# Altium schematic sheet Sheet1.SCHDOC
size 604 x 427 mm
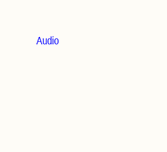
[diagram p0: Sheet1.SCHDOC, top column 1 of 4]
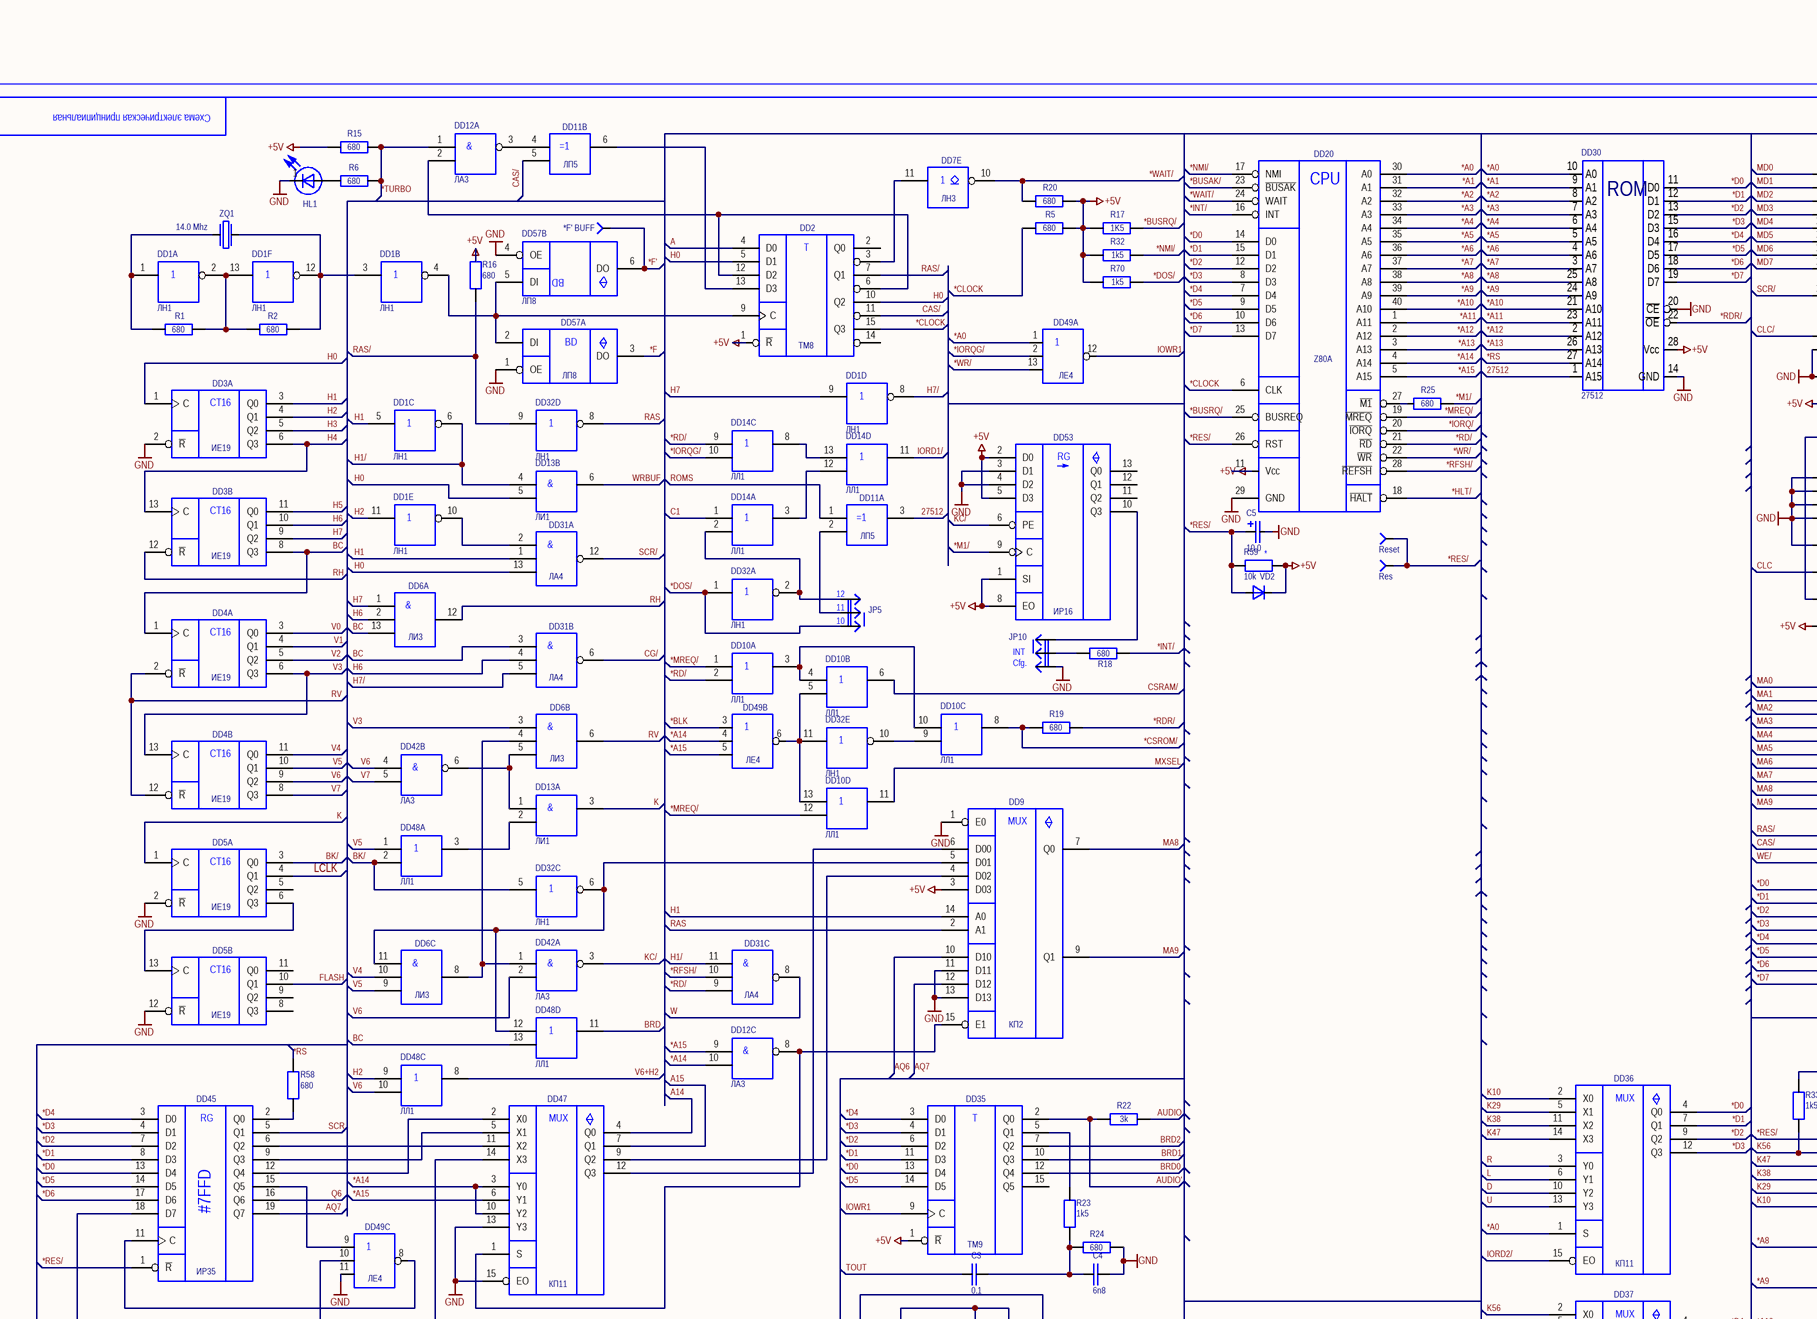
[diagram p1: Sheet1.SCHDOC, top column 3 of 4]
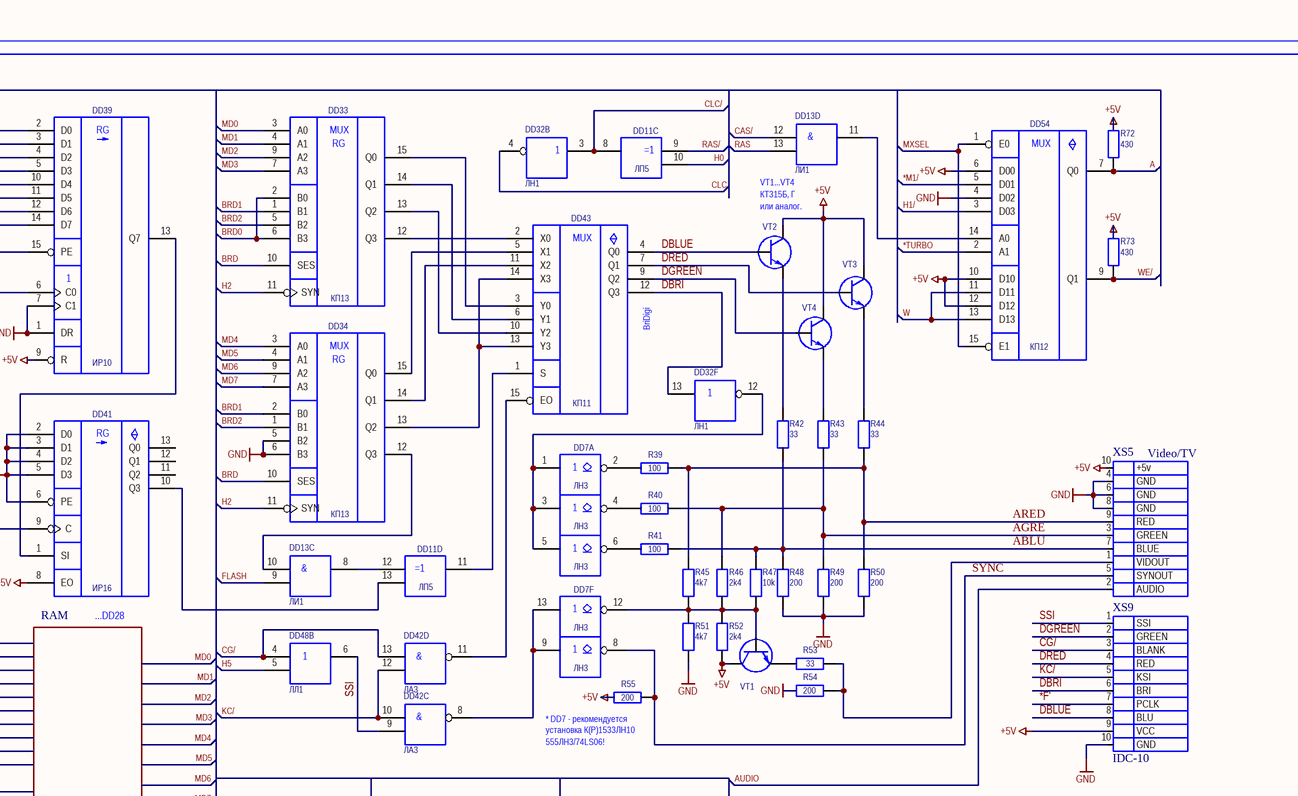
[diagram p2: Sheet1.SCHDOC, top column 4 of 4]
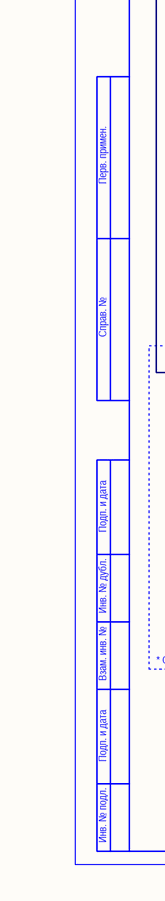
[diagram p3: Sheet1.SCHDOC, bottom column 2 of 4]
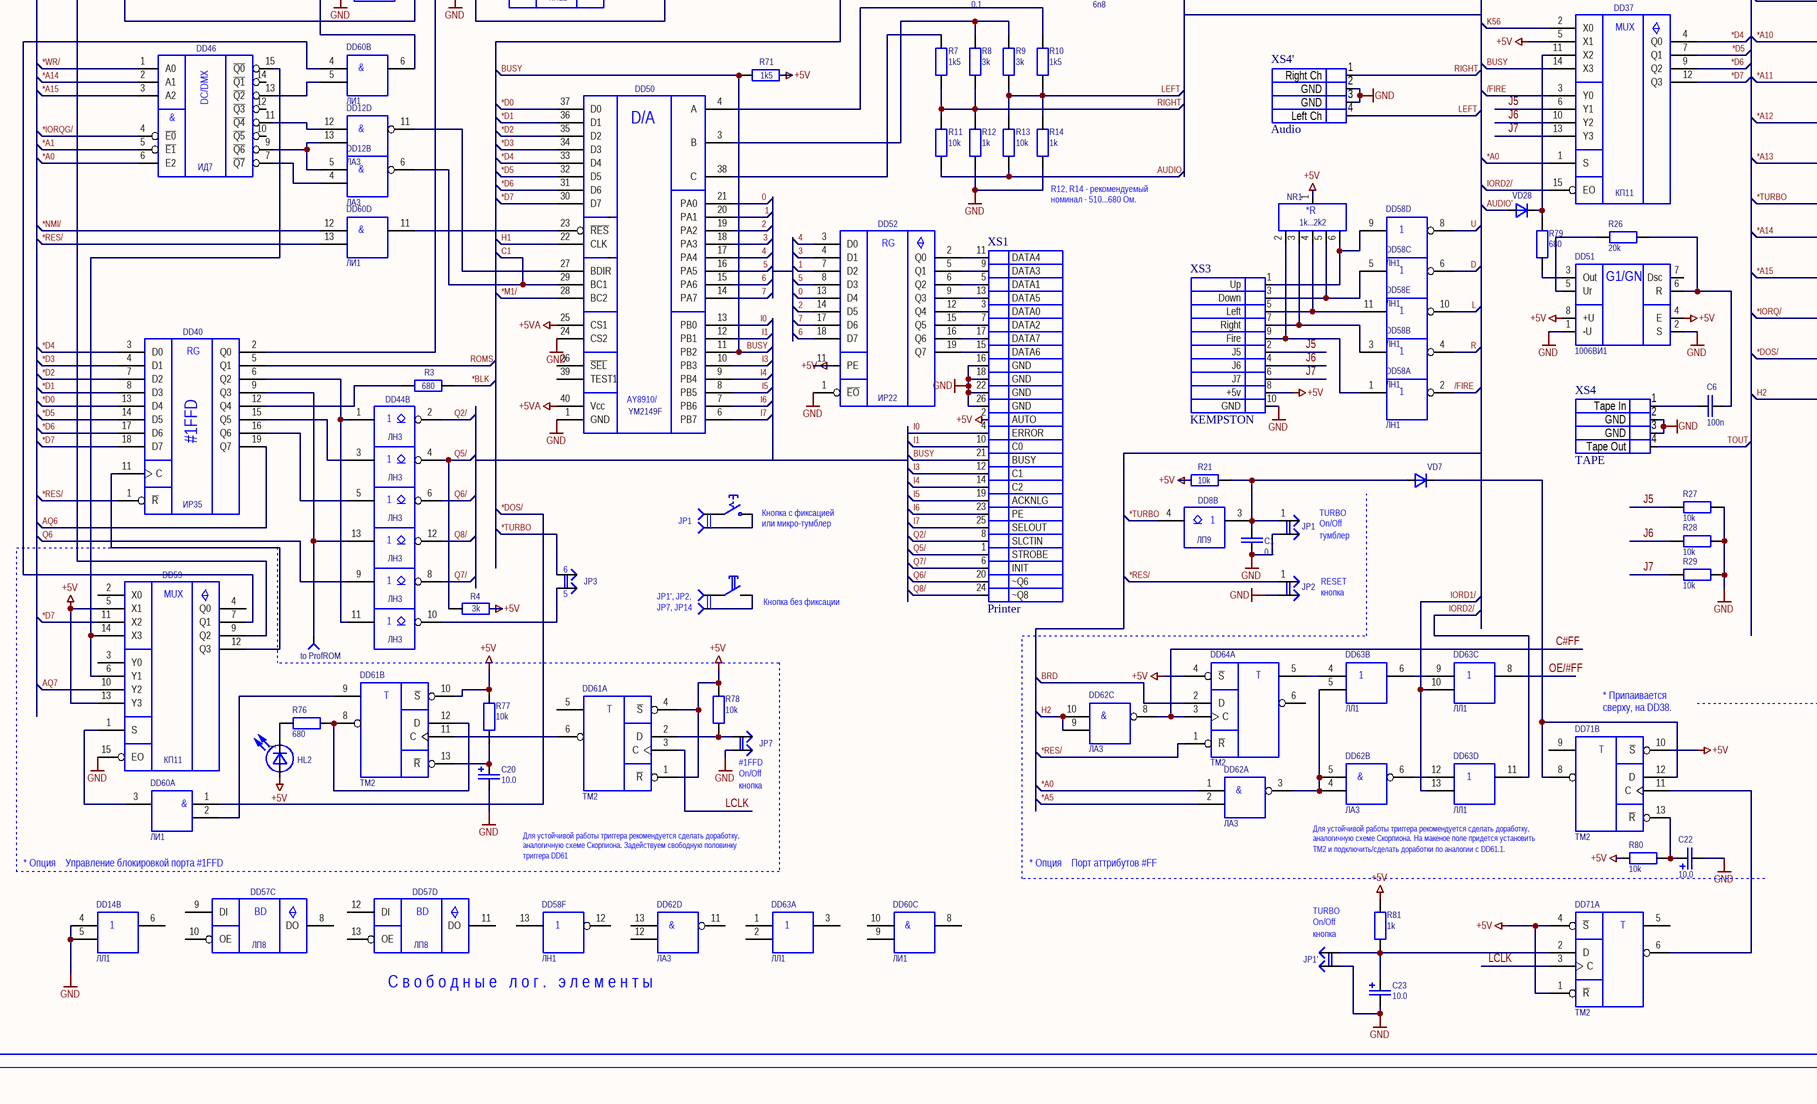
[diagram p4: Sheet1.SCHDOC, bottom column 3 of 4]
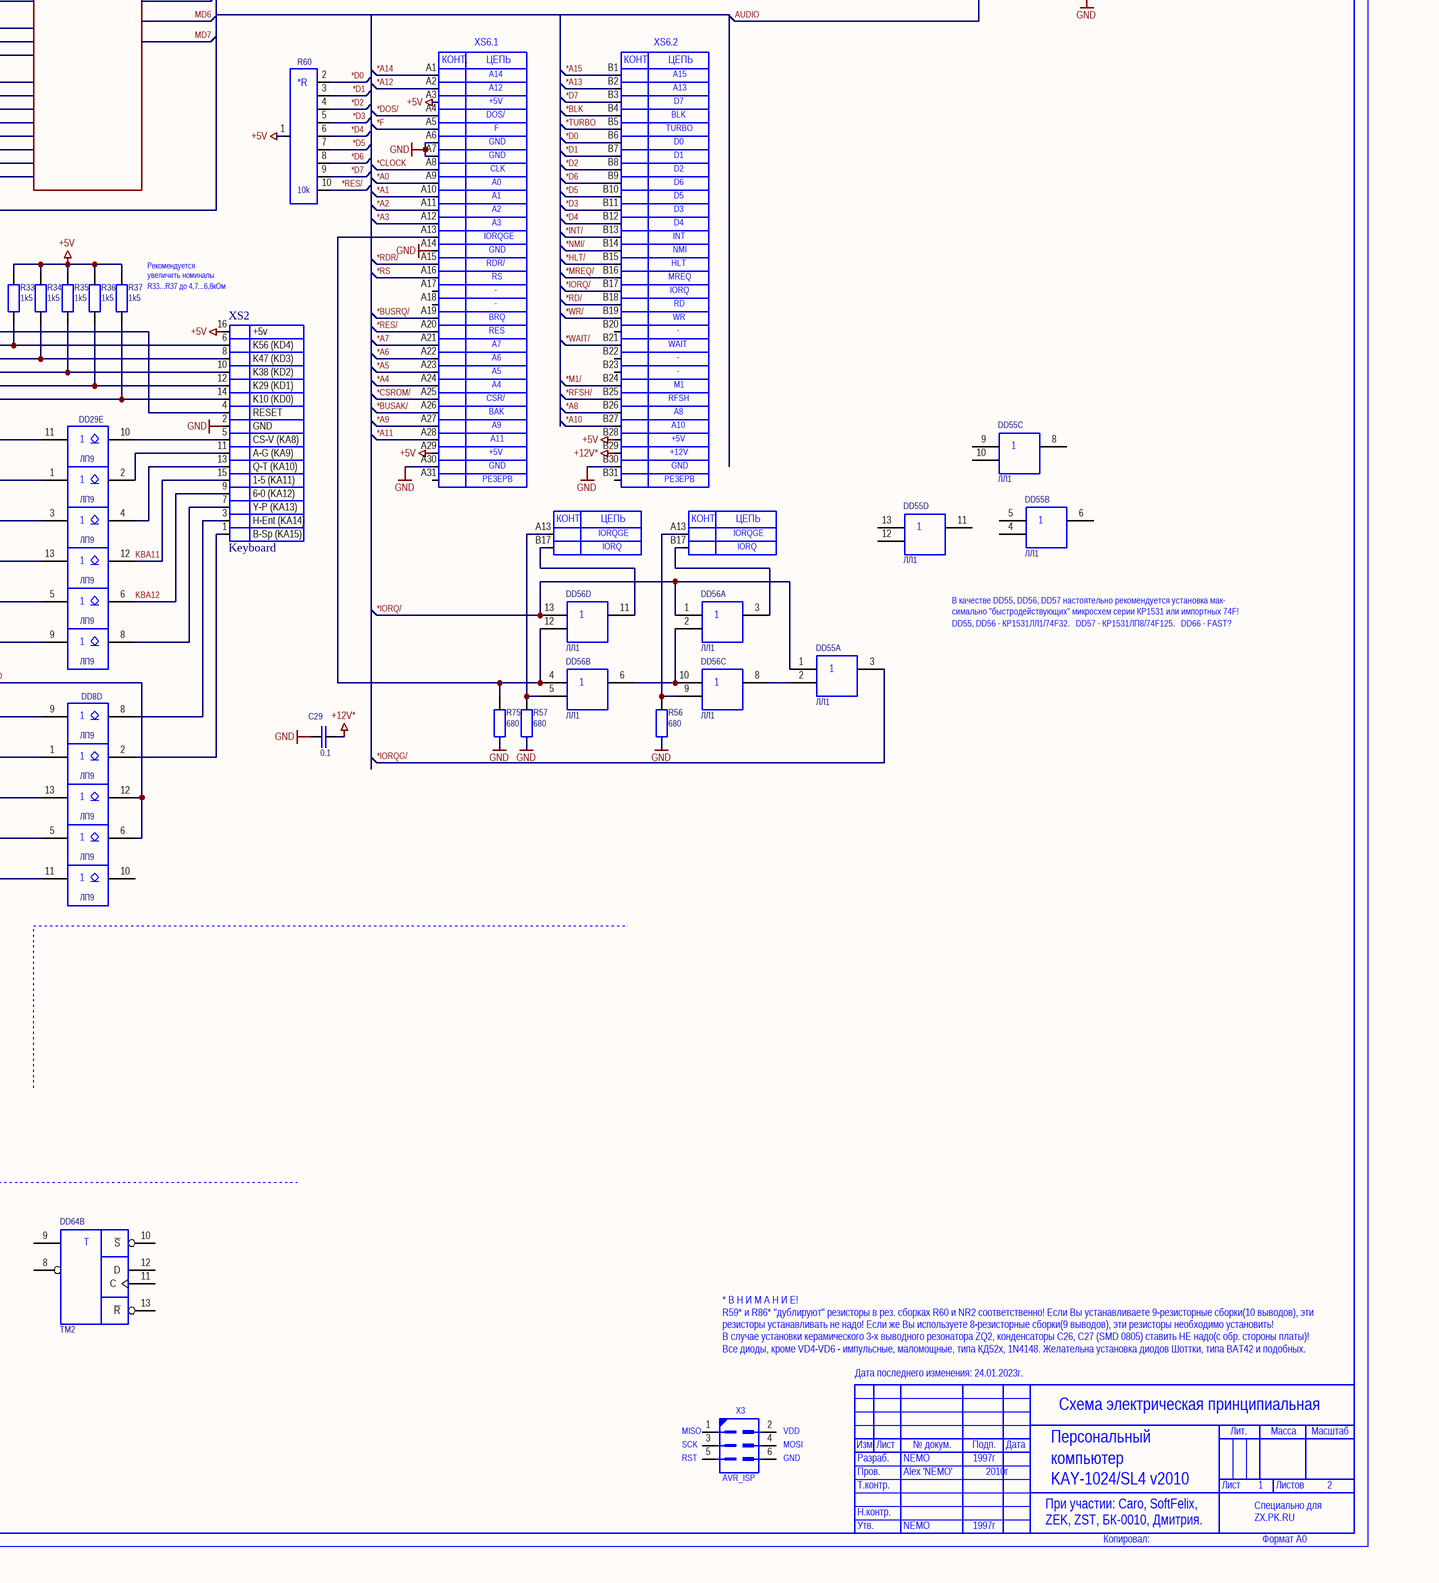
[diagram p5: Sheet1.SCHDOC, bottom column 4 of 4]

## Parts
C1  value 0.1  [CAP]
C3  value 0.1  [CAP]
C4  value 6n8  [CAP]
C5  value 10.0  [AL CAP P=2.5 D=3]  (hidden comment: CP)
C6  value 100n  [CAP]
C20  value 10.0  [AL CAP P=2.5 D=3]  (hidden comment: CP)
C22  value 10.0  [AL CAP P=2.5 D=3]  (hidden comment: CP)
C23  value 10.0  [AL CAP P=2.5 D=3]  (hidden comment: CP)
C29  value 0.1  [CAP]
DD1  Type: ЛН1  [DIP14]  (hidden comment: К555ЛН1)  (parts A,B,C,D,E,F of 6)
DD2  Type: ТМ8  [DIP16]
DD3  Type: ИЕ19  [DIP14]  (parts A,B of 2)
DD4  Type: ИЕ19  [DIP14]  (parts A,B of 2)
DD5  Type: ИЕ19  [DIP14]  (parts A,B of 2)
DD6  Type: ЛИ3  [DIP14]  (parts A,B,C of 3)
DD7  Type: ЛН3  [DIP14]  (parts A,B,C,D,E,F of 6)
DD8  Type: ЛП9  [DIP14]  (parts A,B,C,D,E,F of 6)
DD9  Type: КП2  [DIP16]
DD10  Type: ЛЛ1  [DIP14]  (hidden comment: К555ЛЛ1)  (parts A,B,C,D of 4)
DD11  Type: ЛП5  [DIP14]  (parts A,B,C,D of 4)
DD12  Type: ЛА3  [DIP14]  (hidden comment: К555ЛА3)  (parts A,B,C,D of 4)
DD13  Type: ЛИ1  [DIP14]  (hidden comment: К555ЛИ1)  (parts A,B,C,D of 4)
DD14  Type: ЛЛ1  [DIP14]  (hidden comment: К555ЛЛ1)  (parts A,B,C,D of 4)
DD20  Type: Z80A  [DIP40]
DD29  Type: ЛП9  [DIP14]  (parts A,B,C,D,E,F of 6)
DD30  27512  [DIP28]
DD31  Type: ЛА4  [DIP14]  (parts A,B,C of 3)
DD32  Type: ЛН1  [DIP14]  (hidden comment: К555ЛН1)  (parts A,B,C,D,E,F of 6)
DD33  Type: КП13  [DIP16]
DD34  Type: КП13  [DIP16]
DD35  Type: ТМ9  [DIP16]
DD36  Type: КП11  [DIP16]
DD37  Type: КП11  [DIP16]
DD39  Type: ИР10  [DIP16]
DD40  Type: ИР35  [DIP20]
DD41  Type: ИР16  [DIP14]
DD42  Type: ЛА3  [DIP14]  (hidden comment: К555ЛА3)  (parts A,B,C,D of 4)
DD43  Type: КП11  [DIP16]
DD44  Type: ЛН3  [DIP14]  (parts A,B,C,D,E,F of 6)
DD45  Type: ИР35  [DIP20]
DD46  Type: ИД7  [DIP16]
DD47  Type: КП11  [DIP16]
DD48  Type: ЛЛ1  [DIP14]  (hidden comment: К555ЛЛ1)  (parts A,B,C,D of 4)
DD49  Type: ЛЕ4  [DIP14]  (parts A,B,C of 3)
DD50  (no value)  [DIP40]
DD51  Type: 1006ВИ1  [DIP8]
DD52  Type: ИР22  [DIP20]
DD53  Type: ИР16  [DIP14]
DD54  Type: КП12  [DIP16]
DD55  Type: ЛЛ1  [DIP14]  (hidden comment: К555ЛЛ1)  (parts A,B,C,D of 4)
DD56  Type: ЛЛ1  [DIP14]  (hidden comment: К555ЛЛ1)  (parts A,B,C,D of 4)
DD57  Type: ЛП8  [DIP14]  (parts A,B,C,D of 4)
DD58  Type: ЛН1  [DIP14]  (hidden comment: К555ЛН1)  (parts A,B,C,D,E,F of 6)
DD59  Type: КП11  [DIP16]
DD60  Type: ЛИ1  [DIP14]  (hidden comment: К555ЛИ1)  (parts A,B,C,D of 4)
DD61  Type: ТМ2  [DIP14]  (hidden comment: К555ТМ2)  (parts A,B of 2)
DD62  Type: ЛА3  [DIP14]  (hidden comment: К555ЛА3)  (parts A,B,C,D of 4)
DD63  Type: ЛЛ1  [DIP14]  (hidden comment: К555ЛЛ1)  (parts A,B,C,D of 4)
DD64  Type: ТМ2  [DIP14]  (hidden comment: К555ТМ2)  (parts A,B of 2)
DD71  Type: ТМ2  [DIP14]  (hidden comment: К555ТМ2)  (parts A,B of 2)
HL1  (no value)  [PLS-2]
HL2  LED #1FFD  [PLS-2]  (value not drawn)
JP1  TURBO  [PLS-2]  (value not drawn)
JP1'  TURBO  [PLS-2]  (value not drawn)
JP2  TURBO  [PLS-2]  (value not drawn)
JP3  5 6  [PLS-2]  (value not drawn)
JP5  (no value)  [PLS-3]
JP7  Blk#1FFD  [PLS-2]  (value not drawn)
JP10  INT Cfg  [PLS-3]  (value not drawn)
KP7  Reset  [Socket]
KP8  Res  [Socket]
KP9  to ProfROM  [Socket]
KP10  *F' BUFF  [Socket]
NR1  value 1k...2k2  [SIL6]
R1  value 680  [RES]
R2  value 680  [RES]
R3  value 680  [RES]
R4  value 3k  [RES]
R5  value 680  [RES]
R6  value 680  [RES]
R7  value 1k5  [RES]
R8  value 3k  [RES]
R9  value 3k  [RES]
R10  value 1k5  [RES]
R11  value 10k  [RES]
R12  value 1k  [RES]
R13  value 10k  [RES]
R14  value 1k  [RES]
R15  value 680  [RES]
R16  value 680  [RES]
R17  value 1K5  [RES]
R18  value 680  [RES]
R19  value 680  [RES]
R20  value 680  [RES]
R21  value 10k  [RES]
R22  value 3k  [RES]
R23  value 1k5  [RES]
R24  value 680  [RES]
R25  value 680  [RES]
R26  value 20k  [RES]
R27  value 10k  [RES]
R28  value 10k  [RES]
R29  value 10k  [RES]
R32  value 1k5  [RES]
R33  value 1k5  [RES]
R34  value 1k5  [RES]
R35  value 1k5  [RES]
R36  value 1k5  [RES]
R37  value 1k5  [RES]
R39  value 100  [RES]
R40  value 100  [RES]
R41  value 100  [RES]
R42  value 33  [RES]
R43  value 33  [RES]
R44  value 33  [RES]
R45  value 4k7  [RES]
R46  value 2k4  [RES]
R47  value 10k  [RES]
R48  value 200  [RES]
R49  value 200  [RES]
R50  value 200  [RES]
R51  value 4k7  [RES]
R52  value 2k4  [RES]
R53  value 33  [RES]
R54  value 200  [RES]
R55  value 200  [RES]
R56  value 680  [RES]
R57  value 680  [RES]
R58  value 680  [RES]
R59  value 10k  [RES]
R60  value 10k  [SIL10]
R70  value 1k5  [RES]
R71  value 1k5  [RES]
R72  value 430  [RES]
R73  value 430  [RES]
R75  value 680  [RES]
R76  value 680  [RES]
R77  value 10k  [RES]
R78  value 10k  [RES]
R79  value 680  [RES]
R80  value 10k  [RES]
R81  value 1k  [RES]
SB2  (no value)  (graphical)
SB4  (no value)  (graphical)
VD2  D2  [1N4148]  (value not drawn)
VD7  D7  [1N4148]  (value not drawn)
VD28  D28  [1N4148]  (value not drawn)
VT1  (no value)  [VT]
VT2  (no value)  [VT]
VT3  (no value)  [VT]
VT4  (no value)  [VT]
X6  (no value)  (graphical)
XS1  Printer  [BH-26]
XS2  Keyboard  [BH-16]
XS3  KEMPSTON  [BH-10]
XS4  TAPE  [STEREO_CONN]
XS4'  Audio  [STEREO_CONN]
XS5  Video/TV  [BH-10]
XS6  (no value)  [SLOT62_ZXSLOT(Primary)]  (parts A,B,C,D,E,F,G,H,I,J,K,L,M,N,O,P,Q,R,S,T,U,V,W,X,Y,Z,27,28,29,30,31,32,33,34,35,36,37,38,39,40,41,42,43,44,45,46,47,48,49,50,51,52,53,54,55,56,57,58,59,60,61,62 of 62)
XS7  (no value)  [SLOT62_ZXSLOT(Primary)]  (parts M,48 of 62)
XS8  (no value)  [SLOT62_ZXSLOT(Primary)]  (parts M,48 of 62)
XS9  IDC-10  [BH-10]
XS46  (no value)  (graphical)
XS47  (no value)  (graphical)
XS48  (no value)  (graphical)
XS49  (no value)  (graphical)
ZQ1  value 14.0 Mhz  [HC49]

## Blocks framed on the sheet
* Опция    Управление блокировкой порта #1FFD: C20 DD59-DD61 HL2 JP7 R76-R78

## Sub-sheets
RAM = ?: no entries

## Nets
+5V: DD1.14(+5V) DD2.1(~{R}) DD2.16(+5V) DD3.14(+5V) DD4.14(+5V) DD5.14(+5V) DD6.14(+5V) DD7.14(+5V) DD8.14(+5V) DD9.3(D03) DD9.16(+5V) DD10.14(+5V) DD11.14(+5V) DD12.14(+5V) DD13.14(+5V) DD14.14(+5V) DD20.11(Vcc) DD29.14(+5V) DD30.28(Vcc) DD31.14(+5V) DD32.14(+5V) DD33.16(+5V) DD34.16(+5V) DD35.1(~{R}) DD35.16(+5V) DD36.16(+5V) DD37.5(X1) DD37.16(+5V) DD39.9(R) DD39.16(+5V) DD40.20(+5V) DD41.8(EO) DD41.14(+5V) DD42.14(+5V) DD43.16(+5V) DD44.14(+5V) DD45.20(+5V) DD46.16(+5V) DD47.16(+5V) DD48.14(+5V) DD49.14(+5V) DD51.4(E) DD51.8(+U) DD52.11(PE) DD52.20(+5V) DD53.1(SI) DD53.2(D0) DD53.5(D3) DD53.8(EO) DD53.14(+5V) DD54.6(D00) DD54.10(D10) DD54.12(D12) DD54.16(+5V) DD55.14(+5V) DD56.14(+5V) DD57.14(+5V) DD58.14(+5V) DD59.5(X1) DD59.13(Y3) DD59.16(+5V) DD60.14(+5V) DD61.1(~{R}) DD61.4(~{S}) DD61.10(~{S}) DD61.14(+5V) DD62.14(+5V) DD63.14(+5V) DD64.4(~{S}) DD64.14(+5V) DD71.1(~{R}) DD71.4(~{S}) DD71.10(~{S}) DD71.14(+5V) HL2.2 NR1.1 R4.2 R5.2 R15.1 R16.2 R17.1 R20.2 R21.1 R32.1 R33.2 R34.2 R35.2 R36.2 R37.2 R52.1 R55.1 R59.1 R60.1 R70.1 R71.2 R72.2 R73.2 R77.1 R78.2 R80.2 R81.2 VD2.2 VT1.K VT2.K VT3.K VT4.K XS1.2(AUTO) XS2.16(+5v) XS3.8(+5v) XS5.10(+5v) XS6.A3 XS6.A29 XS6.B28 XS9.9(VCC)
+5VA: DD50.25(CS1) DD50.40(Vcc)
+12V*: C29.2 XS6.B29
GND: C1.2 C4.2 C5.2 C20.2 C22.2 C23.2 C29.1 DD1.7(GND) DD2.8(GND) DD3.2(~{R}) DD3.7(GND) DD4.7(GND) DD5.2(~{R}) DD5.7(GND) DD5.12(~{R}) DD6.7(GND) DD7.7(GND) DD8.7(GND) DD9.1(E0) DD9.8(GND) DD9.11(D11) DD9.13(D13) DD10.7(GND) DD11.7(GND) DD12.7(GND) DD13.7(GND) DD14.4 DD14.5 DD14.7(GND) DD20.29(GND) DD29.7(GND) DD30.14(GND) DD30.20(~{CE}) DD31.7(GND) DD32.7(GND) DD33.8(GND) DD34.5(B2) DD34.6(B3) DD34.8(GND) DD35.8(GND) DD36.8(GND) DD37.8(GND) DD39.1(DR) DD39.7(C1) DD39.8(GND) DD40.10(GND) DD41.2(D0) DD41.3(D1) DD41.4(D2) DD41.5(D3) DD41.6(PE) DD41.7(GND) DD42.7(GND) DD43.8(GND) DD44.7(GND) DD45.10(GND) DD46.8(GND) DD47.8(GND) DD47.13(Y3) DD47.15(EO) DD48.7(GND) DD49.7(GND) DD49.11 DD50.1(GND) DD50.24(CS2) DD51.1(-U) DD51.2(S) DD52.1(~{EO}) DD52.10(GND) DD53.3(D1) DD53.4(D2) DD53.7(GND) DD54.4(D02) DD54.8(GND) DD55.7(GND) DD56.7(GND) DD57.1(OE) DD57.4(OE) DD57.7(GND) DD58.7(GND) DD59.8(GND) DD59.15(EO) DD60.7(GND) DD61.7(GND) DD62.7(GND) DD63.7(GND) DD64.7(GND) DD71.7(GND) HL1.1 JP1.2 JP1'.2 JP2.2 JP7.2 JP10.1 R12.1 R14.1 R24.2 R27.1 R28.1 R29.1 R48.1 R49.1 R50.1 R51.1 R54.1 R56.1 R57.1 R75.1 XS1.16(GND) XS1.18(GND) XS1.22(GND) XS1.26(GND) XS2.2(GND) XS3.10(GND) XS4.2(GND) XS4.3(GND) XS4'.2(GND) XS4'.3(GND) XS5.4(GND) XS5.6(GND) XS5.8(GND) XS6.A6 XS6.A7 XS6.A14 XS6.A30 XS6.B30 XS9.10(GND)
0: DD50.21(PA0) DD52.13(D4)
1: DD50.20(PA1) DD52.7(D2)
2: DD50.19(PA2) DD52.14(D5)
3: DD50.18(PA3) DD52.4(D1)
4: DD50.17(PA4) DD52.3(D0)
5: DD50.16(PA5) DD52.8(D3)
6: DD50.15(PA6) DD52.18(D7)
7: DD50.14(PA7) DD52.17(D6)
27512: DD11.3 DD30.1(A15)
*A0: DD20.30(A0) DD30.10(A0) DD36.1(S) DD37.1(S) DD46.6(E2) DD49.1 DD62.1 XS6.A9
*A1: DD20.31(A1) DD30.9(A1) DD46.5(~{E1}) XS6.A10
*A2: DD20.32(A2) DD30.8(A2) XS6.A11
*A3: DD20.33(A3) DD30.7(A3) XS6.A12
*A4: DD20.34(A4) DD30.6(A4) XS6.A24
*A5: DD20.35(A5) DD30.5(A5) DD62.2 XS6.A23
*A6: DD20.36(A6) DD30.4(A6) XS6.A22
*A7: DD20.37(A7) DD30.3(A7) XS6.A21
*A8: DD20.38(A8) DD29.11 DD30.25(A8) XS6.B26
*A9: DD20.39(A9) DD29.1 DD30.24(A9) XS6.A27
*A10: DD20.40(A10) DD29.3 DD30.21(A10) XS6.B27
*A11: DD20.1(A11) DD29.13 DD30.23(A11) XS6.A28
*A12: DD20.2(A12) DD29.5 DD30.2(A12) XS6.A2
*A13: DD20.3(A13) DD29.9 DD30.26(A13) XS6.B2
*A14: DD8.9 DD12.10 DD20.4(A14) DD46.2(A1) DD47.3(Y0) DD47.10(Y2) DD49.4 XS6.A1
*A15: DD8.1 DD12.9 DD20.5(A15) DD46.3(A2) DD47.6(Y1) DD49.5 XS6.B1
*BLK: DD49.3 R3.2 XS6.B4
*BUSAK/: DD20.23(~{BUSAK}) XS6.A26
*BUSRQ/: DD20.25(BUSREQ) R17.2 XS6.A19
*CLOCK: DD2.15(Q3) DD20.6(CLK) R5.1 XS6.A8
*CSROM/: DD10.8 R19.1 XS6.A25
*D0: DD20.14(D0) DD30.11(D0) DD35.13(D4) DD36.4(Q0) DD40.13(D4) DD45.13(D4) DD50.37(D0) R60.2 XS6.B6
*D1: DD20.15(D1) DD30.12(D1) DD35.11(D3) DD36.7(Q1) DD40.8(D3) DD45.8(D3) DD50.36(D1) R60.3 XS6.B7
*D2: DD20.12(D2) DD30.13(D2) DD35.6(D2) DD36.9(Q2) DD40.7(D2) DD45.7(D2) DD50.35(D2) R60.4 XS6.B8
*D3: DD20.8(D3) DD30.15(D3) DD35.4(D1) DD36.12(Q3) DD40.4(D1) DD45.4(D1) DD50.34(D3) R60.5 XS6.B11
*D4: DD20.7(D4) DD30.16(D4) DD35.3(D0) DD37.4(Q0) DD40.3(D0) DD45.3(D0) DD50.33(D4) R60.6 XS6.B12
*D5: DD20.9(D5) DD30.17(D5) DD35.14(D5) DD37.7(Q1) DD40.14(D5) DD45.14(D5) DD50.32(D5) R60.7 XS6.B10
*D6: DD20.10(D6) DD30.18(D6) DD37.9(Q2) DD40.17(D6) DD45.17(D6) DD50.31(D6) R60.8 XS6.B9
*D7: DD20.13(D7) DD30.19(D7) DD37.12(Q3) DD40.18(D7) DD50.30(D7) DD59.11(X2) R60.9 XS6.B3
*DOS/: DD8.5 DD32.1 DD60.1 JP5.1 R70.2 XS6.A4
*F: DD57.3(DO) XS6.A5
*F': DD57.6(DO) KP10.1 XS9.7(PCLK)
*HLT/: DD20.18(~{HALT}) XS6.B15
*INT/: DD20.16(INT) R18.2 XS6.B13
*IORQ/: DD8.13 DD20.20(~{IORQ}) DD55.1 DD56.1 DD56.13 XS6.B17
*IORQG/: DD14.10 DD46.4(~{E0}) DD49.2 DD55.3
*M1/: DD50.28(BC2) DD53.9(C) DD54.5(D01) R25.2 XS6.B24
*MREQ/: DD10.1 DD10.12 DD20.19(~{MREQ}) XS6.B16
*NMI/: DD20.17(NMI) DD60.12 R32.2 XS6.B14
*RD/: DD10.2 DD14.9 DD20.21(~{RD}) DD31.9 XS6.B18
*RDR/: DD30.22(~{OE}) R19.2 XS6.A15
*RES/: C5.1 DD20.26(RST) DD40.1(~{R}) DD45.1(~{R}) DD60.13 DD64.1(~{R}) JP2.1 KP7.1 KP8.1 R59.2 R60.10 VD2.1 XS2.4(RESET) XS6.A20
*RFSH/: DD20.28(~{REFSH}) DD31.10 XS6.B25
*RS: DD30.27(A14) R58.2 XS6.A16
*TURBO: DD8.4 DD8.6 DD8.12 DD12.1 DD54.2(A1) JP3.2 R6.2 R15.2 XS6.B5
*WAIT/: DD7.10 DD20.24(WAIT) R20.1 XS6.B21
*WR/: DD20.22(~{WR}) DD46.1(A0) DD49.13 XS6.B19
/FIRE: DD37.3(Y0) DD58.2
A: DD2.4(D0) DD54.7(Q0) R72.1
A14: DD47.4(Q0)
A15: DD47.7(Q1)
ABLU: R41.2 R42.1 R47.2 R48.2 XS5.7(BLUE)
AGRE: R40.2 R43.1 R46.2 R49.2 XS5.3(GREEN)
AQ6: DD9.10(D10) DD40.19(Q7)
AQ7: DD9.12(D12) DD45.19(Q7) DD59.10(Y2)
ARED: R39.2 R44.1 R45.2 R50.2 XS5.9(RED)
AUDIO: R11.1 R13.1 R22.2 XS5.2(AUDIO)
AUDIO': DD35.2(Q0) R22.1 VD28.1
BC: DD3.8(Q3) DD4.1(C) DD6.13 DD31.3 DD48.13
BK/: DD5.3(Q0) DD32.5 DD48.2
BRD: DD33.10(SES) DD34.10(SES) DD48.11 DD64.2(D)
BRD0: DD33.2(B0) DD33.6(B3) DD35.12(Q4)
BRD1: DD33.1(B1) DD34.2(B0) DD35.10(Q3)
BRD2: DD33.5(B2) DD34.1(B1) DD35.7(Q2)
BUSY: DD37.14(X3) DD50.11(PB2) R71.1 XS1.21(BUSY)
C1: DD12.6 DD14.1 DD50.29(BC1)
C#FF: DD62.8 DD64.3(C)
CAS/: DD2.11 DD11.5 DD13.12
CG/: DD31.6 DD42.13 DD48.4 XS9.3(BLANK)
CLC: DD32.4 DD41.9(C)
CLC/: DD11.8 DD32.3 DD39.6(C0)
CSRAM/: DD10.6
D: DD36.10(Y2) DD58.6
DBLUE: DD43.4(Q0) VT2.B XS9.8(BLU)
DBRI: DD32.13 DD43.12(Q3) XS9.6(BRI)
DGREEN: DD43.9(Q2) VT4.B XS9.2(GREEN)
DRED: DD43.7(Q1) VT3.B XS9.4(RED)
FLASH: DD5.10(Q1) DD13.9
H0: DD2.5(D1) DD2.10(Q2) DD3.1(C) DD11.10 DD13.5 DD31.13
H1: DD1.5 DD3.3(Q0) DD9.14(A0) DD31.1 DD50.22(CLK)
H1/: DD1.6 DD13.4 DD31.11 DD54.3(D03)
H2: DD1.11 DD3.4(Q1) DD8.11 DD33.11(SYN) DD34.11(SYN) DD48.9 DD62.9 DD62.10
H3: DD3.5(Q2)
H4: DD3.6(Q3) DD3.13(C)
H5: DD3.11(Q0) DD48.5
H6: DD3.10(Q1) DD6.2 DD31.4
H7: DD1.9 DD3.9(Q2) DD6.1
H7/: DD1.8 DD31.5
I0: DD50.13(PB0) XS1.4(ERROR)
I1: DD50.12(PB1) XS1.10(C0)
I3: DD50.10(PB3) XS1.12(C1)
I4: DD50.9(PB4) XS1.14(C2)
I5: DD50.8(PB5) XS1.19(ACKNLG)
I6: DD50.7(PB6) XS1.23(PE)
I7: DD50.6(PB7) XS1.25(SELOUT)
IORD1/: DD14.11 DD63.10 DD63.13
IORD2/: DD36.15(EO) DD37.15(EO) DD63.11
IOWR1: DD35.9(C) DD49.12
J5: DD37.6(Y1) R27.2 XS3.2(J5)
J6: DD37.10(Y2) R28.2 XS3.4(J6)
J7: DD37.13(Y3) R29.2 XS3.6(J7)
K: DD5.1(C) DD13.3
K10: DD36.2(X0) R37.1 XS2.14(K10_(KD0))
K29: DD36.5(X1) R36.1 XS2.12(K29_(KD1))
K38: DD36.11(X2) R35.1 XS2.10(K38_(KD2))
K47: DD36.14(X3) R34.1 XS2.8(K47_(KD3))
K56: DD37.2(X0) R33.1 XS2.6(K56_(KD4))
KBA11: DD29.12 XS2.15(1-5_(KA11))
KBA12: DD29.6 XS2.9(6-0_(KA12))
KC/: DD42.3 DD42.10 DD42.12 DD53.6(PE) XS9.5(KSI)
L: DD36.6(Y1) DD58.10
LCLK: DD5.4(Q1) DD61.3(C) DD71.3(C)
LEFT: R9.1 R10.1 R13.2 R14.2 XS4'.4(Left_Ch)
MA8: DD9.7(Q0)
MA9: DD9.9(Q1)
MD0: DD33.3(A0) DD39.2(D0)
MD1: DD33.4(A1) DD39.3(D1)
MD2: DD33.9(A2) DD39.4(D2)
MD3: DD33.7(A3) DD39.5(D3)
MD4: DD34.3(A0) DD39.10(D4)
MD5: DD34.4(A1) DD39.11(D5)
MD6: DD34.9(A2) DD39.12(D6)
MD7: DD34.7(A3) DD39.14(D7)
MXSEL: DD10.11 DD54.1(E0) DD54.15(E1)
OE/#FF: DD63.8
Q2/: DD44.2 XS1.8(SLCTIN)
Q5/: DD44.4 R4.1 XS1.1(STROBE)
Q6: DD44.9 DD45.16(Q6)
Q6/: DD44.6 XS1.20(~Q6)
Q7/: DD44.8 XS1.6(INIT)
Q8/: DD44.12 XS1.24(~Q8)
R: DD36.3(Y0) DD58.4
RAS: DD9.2(A1) DD13.13 DD32.8
RAS/: DD2.7(Q1) DD11.9 DD32.9 R16.1
RH: DD3.12(~{R}) DD6.12
RIGHT: R7.1 R8.1 R11.2 R12.2 XS4'.1(Right_Ch)
ROMS: DD11.1 DD40.5(Q1)
RV: DD4.2(~{R}) DD4.12(~{R}) DD6.6
SCR: DD45.5(Q1)
SCR/: DD31.12 DD39.15(PE)
SSI: DD42.9 DD48.6 XS9.1(SSI)
SYNC: DD7.8 R55.2 XS5.5(SYNOUT)
TOUT: C3.1 XS4.4(Tape_Out)
U: DD36.13(Y3) DD58.8
V0: DD4.3(Q0)
V1: DD4.4(Q1)
V2: DD4.5(Q2)
V3: DD4.6(Q3) DD4.13(C) DD6.3
V4: DD4.11(Q0) DD6.10
V5: DD4.10(Q1) DD6.9 DD48.1
V6: DD4.9(Q2) DD42.2 DD42.4 DD48.10
V6+H2: DD48.8
V7: DD4.8(Q3) DD42.5
W: DD31.8 DD54.11(D11) DD54.13(D13)
WE/: DD54.9(Q1) R73.1
WRBUF: DD13.6
NetC1_1: C1.1 DD8.3 JP1.1 R21.2 VD7.1
NetC3_2: C3.2 C4.1 R23.1 R24.1
NetC6_1: C6.1 XS4.1(Tape_In)
NetC6_2: C6.2 DD51.6(R) R26.1
NetC20_1: C20.1 DD61.13(~{R}) R77.2
NetC22_1: C22.1 DD71.13(~{R}) R80.1
NetC23_1: C23.1 DD71.2(D) JP1'.1 R81.1
NetDD1_1: DD1.1 R1.1 ZQ1.1
NetDD1_2: DD1.2 DD1.13 R1.2 R2.1
NetDD1_3: DD1.3 DD1.12 R2.2 ZQ1.2
NetDD1_4: DD1.4 DD2.9(C) DD57.2(DI) DD57.5(DI)
NetDD1_10: DD1.10 DD31.2
NetDD2_3: DD2.3 DD7.11
NetDD2_6: DD2.6 DD2.12(D2) DD12.2
NetDD2_13: DD2.13(D3) DD11.6
NetDD5_6: DD5.6(Q3) DD5.13(C)
NetDD6_4: DD6.4 DD6.8 DD42.1
NetDD6_5: DD6.5 DD13.1 DD42.6
NetDD6_11: DD6.11 DD9.5(D01) DD32.6 DD48.12
NetDD7_1: DD7.1 DD7.3 DD7.5 DD32.12
NetDD7_2: DD7.2 R39.1
NetDD7_4: DD7.4 R40.1
NetDD7_6: DD7.6 R41.1
NetDD7_9: DD7.9 DD7.13 DD42.8
NetDD7_12: DD7.12 R45.1 R46.1 R47.1 R51.2 R52.2 VT1.B
NetDD8_2: DD8.2 XS2.1(B-Sp_(KA15))
NetDD8_8: DD8.8 XS2.3(H-Ent_(KA14))
NetDD9_4: DD9.4(D02) DD47.9(Q2)
NetDD9_6: DD9.6(D00) DD47.12(Q3)
NetDD9_15: DD9.15(E1) DD12.8 DD47.1(S)
NetDD10_3: DD10.3 DD10.4 DD10.10
NetDD10_5: DD10.5 DD10.13 DD32.11 DD49.6
NetDD10_9: DD10.9 DD32.10
NetDD11_2: DD11.2 JP5.2
NetDD11_4: DD11.4 DD12.3
NetDD11_11: DD11.11 DD43.1(S)
NetDD11_12: DD11.12 DD13.8
NetDD11_13: DD11.13 DD41.10(Q3)
NetDD12_4: DD12.4 DD46.7(~{Q7})
NetDD12_5: DD12.5 DD12.13 DD46.9(~{Q6})
NetDD12_11: DD12.11 DD50.27(BDIR)
NetDD12_12: DD12.12 DD46.11(~{Q4})
NetDD13_2: DD13.2 DD48.3
NetDD13_10: DD13.10 DD34.12(Q3)
NetDD13_11: DD13.11 DD54.14(A0)
NetDD14_2: DD14.2 DD32.2 JP5.3
NetDD14_3: DD14.3 DD14.12
NetDD14_8: DD14.8 DD14.13
NetDD20_27: DD20.27(~{M1}) R25.1
NetDD29_2: DD29.2 XS2.11(A-G_(KA9))
NetDD29_4: DD29.4 XS2.13(Q-T_(KA10))
NetDD29_8: DD29.8 XS2.7(Y-P_(KA13))
NetDD29_10: DD29.10 XS2.5(CS-V_(KA8))
NetDD33_12: DD33.12(Q3) DD43.2(X0)
NetDD33_13: DD33.13(Q2) DD43.10(Y2)
NetDD33_14: DD33.14(Q1) DD43.6(Y1)
NetDD33_15: DD33.15(Q0) DD43.3(Y0)
NetDD34_13: DD34.13(Q2) DD43.13(Y3) DD43.14(X3)
NetDD34_14: DD34.14(Q1) DD43.11(X2)
NetDD34_15: DD34.15(Q0) DD43.5(X1)
NetDD35_5: DD35.5(Q1) R23.2
NetDD37_11: DD37.11(X2) R79.2 VD28.2
NetDD39_13: DD39.13(Q7) DD41.1(SI)
NetDD40_2: DD40.2(Q0) DD47.14(X3)
NetDD40_6: DD40.6(Q2) DD44.1 DD44.11
NetDD40_9: DD40.9(Q3) DD44.13 KP9.1
NetDD40_11: DD40.11(C) DD59.12(Q3)
NetDD40_12: DD40.12(Q4) R3.1
NetDD40_15: DD40.15(Q5) DD44.3
NetDD40_16: DD40.16(Q6) DD44.5
NetDD42_11: DD42.11 DD43.15(EO)
NetDD44_10: DD44.10 JP3.1
NetDD45_2: DD45.2(Q0) R58.1
NetDD45_6: DD45.6(Q2) DD47.11(X2)
NetDD45_9: DD45.9(Q3) DD47.5(X1)
NetDD45_11: DD45.11(C) DD49.8
NetDD45_12: DD45.12(Q4) DD47.2(X0)
NetDD45_15: DD45.15(Q5) DD49.9
NetDD45_18: DD45.18(D7) DD59.9(Q2)
NetDD46_13: DD46.13(~{Q2}) DD60.5
NetDD46_15: DD46.15(~{Q0}) DD59.6(Y1) DD59.14(X3)
NetDD49_10: DD49.10 DD60.6
NetDD50_3: DD50.3(B) R8.2 R9.2
NetDD50_4: DD50.4(A) R10.2
NetDD50_23: DD50.23(~{RES}) DD60.11
NetDD50_38: DD50.38(C) R7.2
NetDD51_3: DD51.3(Out) R79.1
NetDD51_5: DD51.5(Ur) R26.2
NetDD52_2: DD52.2(Q0) XS1.11(DATA4)
NetDD52_5: DD52.5(Q1) XS1.9(DATA3)
NetDD52_6: DD52.6(Q2) XS1.5(DATA1)
NetDD52_9: DD52.9(Q3) XS1.13(DATA5)
NetDD52_12: DD52.12(Q4) XS1.3(DATA0)
NetDD52_15: DD52.15(Q5) XS1.7(DATA2)
NetDD52_16: DD52.16(Q6) XS1.17(DATA7)
NetDD52_19: DD52.19(Q7) XS1.15(DATA6)
NetDD53_10: DD53.10(Q3) JP10.3
NetDD55_2: DD55.2 DD56.8
NetDD56_2: DD56.2 DD56.6 DD56.10
NetDD56_3: DD56.3 XS8.B17
NetDD56_4: DD56.4 DD56.12 R75.2 XS6.A13
NetDD56_5: DD56.5 R57.2 XS7.A13
NetDD56_9: DD56.9 R56.2 XS8.A13
NetDD56_11: DD56.11 XS7.B17
NetDD58_1: DD58.1 NR1.2 XS3.9(Fire)
NetDD58_3: DD58.3 NR1.3 XS3.7(Right)
NetDD58_5: DD58.5 NR1.5 XS3.3(Down)
NetDD58_9: DD58.9 NR1.6 XS3.1(Up)
NetDD58_11: DD58.11 NR1.4 XS3.5(Left)
NetDD59_1: DD59.1(S) DD60.3
NetDD59_7: DD59.7(Q1) DD60.4
NetDD60_2: DD60.2 DD61.9
NetDD61_2: DD61.2(D) JP7.1 R78.1
NetDD61_6: DD61.6 DD61.11(C)
NetDD61_8: DD61.8 DD61.12(D) R76.1
NetDD62_3: DD62.3 DD62.4 DD62.5 DD63.5
NetDD62_6: DD62.6 DD63.12
NetDD63_4: DD63.4 DD64.5
NetDD63_6: DD63.6 DD63.9
NetDD71_6: DD71.6 DD71.11(C)
NetDD71_8: DD71.8 DD71.12(D) VD7.2
NetHL1_2: HL1.2 R6.1
NetHL2_1: HL2.1 R76.2
NetJP10_2: JP10.2 R18.1
NetR42_2: R42.2 VT2.E
NetR43_2: R43.2 VT4.E
NetR44_2: R44.2 VT3.E
NetR53_1: R53.1 VT1.E
NetR53_2: R53.2 R54.2 XS5.1(VIDOUT)
NetSB2_1: SB2.1 XS49.1
NetSB2_2: SB2.2 XS48.1
NetSB4_1: SB4.1 XS46.1
NetSB4_2: SB4.2 XS47.1

Not connected (* = marked no-connect by the designer): DD2 2(Q0) 14; DD5 5(Q2) 8(Q3) 9(Q2) 11(Q0); DD8 10; DD14 6; DD35 15(Q5); DD41 11(Q2) 12(Q1) 13(Q0); DD46 10(~{Q5}) 12(~{Q3}) 14(~{Q1}); DD50 2(N.C.) 5(N.C.) 26(~{SEL}) 39(TEST1); DD51 7(Dsc); DD53 11(Q2) 12(Q1) 13(Q0); DD55 4 5 6 8 9 10 11 12 13; DD57 8(DO) 9(DI) 10(OE) 11(DO) 12(DI) 13(OE); DD58 12 13; DD59 2(X0) 3(Y0) 4(Q0); DD60 8 9 10; DD61 5; DD62 11 12 13; DD63 1 2 3; DD64 6 8 9 10(~{S}) 11(C) 12(D) 13(~{R}); DD71 5 9; X6 1 2 3 4 5 6; XS6 A17 A18 A31 B20 B22 B23 B31

## Notes on the sheet
- Audio
- Схема электрическая принципиальная
- (near VT2) или аналог.
- КТ315Б, Г
- (near DD13) VT1...VT4
- (near DD43) BriDigi
- (near R59) *
- (near JP5) 10
- (near JP5) 11
- (near JP5) 12
- (near JP10) Cfg.
- (near JP10) INT
- (near DD41) ...DD28
- (near R55) 555ЛН3/74LS06!
- (near R55) установка К(Р)1533ЛН10
- (near R55) * DD7 - рекомендуется
- (near XS6) КОНТ.
- (near XS6) XS6.1
- (near XS6) ЦЕПЬ
- (near XS6) A14
- (near XS6) A12
- (near XS6) XS6.2
- (near XS6) A15
- (near XS6) A13
- (near XS6) DOS/
- (near XS6) +5V
- (near XS6) GND
- F
- (near XS6) TURBO
- (near XS6) BLK
- (near XS6) D7
- (near XS6) D0
- (near XS6) D1
- (near XS6) CLK
- (near XS6) A0
- (near XS6) A1
- (near XS6) A2
- (near XS6) A3
- (near XS6) D2
- (near XS6) D6
- (near XS6) D5
- (near XS6) D3
- (near XS6) D4
- R33...R37 до 4,7...6,8кОм
- (near R37) увеличить номиналы
- (near R37) Рекомендуется
- (near XS6) IORQGE
- (near XS6) RDR/
- (near XS6) RS
- -
- (near XS6) MREQ
- (near XS6) IORQ
- (near XS6) HLT
- (near XS6) INT
- (near XS6) NMI
- (near XS6) BRQ
- (near XS6) RES
- (near XS6) A7
- (near XS6) A6
- (near XS6) WAIT
- (near XS6) WR
- (near XS6) RD
- (near DD45) #7FFD
- (near XS6) CSR/
- (near XS6) BAK
- (near XS6) A5
- (near XS6) A4
- (near XS6) A9
- (near XS6) RFSH
- (near XS6) A10
- (near XS6) M1
- (near XS6) A8
- (near XS6) РЕЗЕРВ
- (near XS6) A11
- (near XS6) +12V
- (near XS7) КОНТ.
- (near XS7) IORQGE
- (near XS7) IORQ
- (near XS8) КОНТ.
- (near XS8) IORQGE
- (near XS8) ЦЕПЬ
- (near XS8) IORQ
- DD55, DD56 - КР1531ЛЛ1/74F32.   DD57 - КР1531ЛП8/74F125.   DD66 - FAST?
- симально "быстродействующих" микросхем серии КР1531 или импортных 74F!
- В качестве DD55, DD56, DD57 настоятельно рекомендуется установка мак-
- номинал - 510...680 Ом.
- (near R14) R12, R14 - рекомендуемый
- Перв. примен.
- (near DD50) AY8910/
- (near DD40) #1FFD
- Справ. №
- JP1
- (near SB4) или микро-тумблер
- (near SB4) Кнопка с фиксацией
- (near JP1) тумблер
- (near JP1) On/Off
- (near JP1) TURBO
- (near JP3) 5
- (near JP3) 6
- JP7, JP14
- (near XS48) JP1', JP2,
- (near SB2) Кнопка без фиксации
- (near JP2) кнопка
- (near JP2) RESET
- Подп. и дата
- (near DD71) сверху, на DD38.
- (near DD71) * Припаивается
- Инв. № дубл.
- (near JP7) кнопка
- (near JP7) On/Off
- (near JP7) #1FFD
- * В Н И М А Н И Е!
- Взам. инв. №
- триггера DD61
- аналогичную схеме Скорпиона. Задействуем свободную половинку
- Для устойчивой работы триггера рекомендуется сделать доработку,
- * Опция    Порт аттрибутов #FF
- ТМ2 и подключить/сделать доработки по аналогии с DD61.1.
- (near DD71) аналогичную схеме Скорпиона. На макеное поле придется установить
- (near DD71) Для устойчивой работы триггера рекомендуется сделать доработку,
- Все диоды, кроме VD4-VD6 - импульсные, маломощные, типа КД52х, 1N4148. Желательна установка диодов Шоттки, типа BAT42 и подобных.
- В случае установки керамического 3-х выводного резонатора ZQ2, конденсаторы С26, С27 (SMD 0805) ставить НЕ надо(с обр. стороны платы)!
- резисторы устанавливать не надо! Если же Вы используете 8-резисторные сборки(9 выводов), эти резисторы необходимо установить!
- R59* и R86* "дублируют" резисторы в рез. сборках R60 и NR2 соответственно! Если Вы устанавливаете 9-резисторные сборки(10 выводов), эти
- (near JP1') кнопка
- On/Off
- TURBO
- (near X6) MISO
- (near X6) X3
- (near X6) VDD
- Дата последнего изменения: 24.01.2023г.
- Лит.
- Масса
- Масштаб
- С в о б о д н ы е   л о г .   э л е м е н т ы
- (near X6) SCK
- (near X6) RST
- (near X6) AVR_ISP
- (near X6) MOSI
- (near X6) GND
- Изм.
- Разраб.
- Пров.
- Т.контр.
- Лист
- NEMO                  1997г
- Alex 'NEMO'              2010г
- № докум.
- Подп.
- Дата
- KAY-1024/SL4 v2010
- компьютер
- Персональный
- 1
- Листов
- 2
- Инв. № подл.
- Н.контр.
- Утв.
- ZEK, ZST, БК-0010, Дмитрия.
- При участии: Caro, SoftFelix,
- Копировал:
- ZX.PK.RU
- Специально для
- Формат А0
- (in symbol 1006VI1) G1/GN
- (in symbol 27512) ROM
- (in symbol NR6) *R
- (in symbol NR10) *R
- (in symbol YM2149F) D/A
- (in symbol Z80) CPU
- (in symbol К555ИД7) DC/DMX; &
- (in symbol К555ИЕ19, part A) CT16
- (in symbol К555ИЕ19, part B) CT16
- (in symbol К555ИР10) RG
- (in symbol К555ИР16_2) RG
- (in symbol К555ИР22) RG
- (in symbol К555ИР35) RG
- (in symbol К555КП11) MUX
- (in symbol К555КП12) MUX
- (in symbol К555КП13_2) MUX; RG
- (in symbol К555ЛА3, part A) &
- (in symbol К555ЛА3, part B) &
- (in symbol К555ЛА3, part C) &
- (in symbol К555ЛА3, part D) &
- (in symbol К555ЛА4, part A) &
- (in symbol К555ЛА4, part B) &
- (in symbol К555ЛА4, part C) &
- (in symbol К555ЛИ1, part A) &
- (in symbol К555ЛИ1, part B) &
- (in symbol К555ЛИ1, part C) &
- (in symbol К555ЛИ1, part D) &
- (in symbol К555ЛИ3, part A) &
- (in symbol К555ЛИ3, part B) &
- (in symbol К555ЛИ3, part C) &
- (in symbol К555ЛП8, part A) BD
- (in symbol К555ЛП8, part B) BD
- (in symbol К555ЛП8, part C) BD
- (in symbol К555ЛП8, part D) BD
- (in symbol К555ТМ2, part A) T
- (in symbol К555ТМ2, part B) T
- (in symbol К555ТМ8) T
- (in symbol К555ТМ9) T

## Library data of the parts
C1 C3 C4 C6 C29 = C: Type: C
DD2 = К555ТМ8
DD3-DD5 = К555ИЕ19
DD6 = К555ЛИ3
DD7 DD44 = К555ЛН2
DD8 DD29 = К555ЛП9
DD9 DD54 = К555КП12
DD11 = К555ЛП5
DD20 = Z80
DD31 = К555ЛА4
DD33 DD34 = К555КП13_2
DD35 = К555ТМ9
DD36 DD37 DD43 DD47 DD59 = К555КП11
DD39 = К555ИР10
DD40 DD45 = К555ИР35
DD41 DD53 = К555ИР16_2
DD46 = К555ИД7
DD49 = К555ЛЕ4
DD50 = YM2149F: Type: YM2149F
DD51 = 1006VI1
DD52 = К555ИР22
DD57 = К555ЛП8
HL1 HL2 = SVETODIOD: Type: SVETODIOD
JP1 JP1' JP2 JP3 JP7 = JUMPER2: Type: JUMPER2
JP5 JP10 = JUMPER3: Type: JUMPER3
KP7-KP10 XS46-XS49 = XS: Type: XS
NR1 = NR6: Type: NR6
R1-R29 R32-R37 R39-R59 R70-R73 R75-R81 = RES: Type: RES
R60 = NR10: Type: NR10
SB2 SB4 = BUTTON: Type: BUTTON
VD2 VD7 VD28 = DIOD_2: Type: DIOD_2
VT1-VT4 = VT_NPN: Type: VT_NPN
X6 = ICD6: Type: ICD6
XS1 = IDC-26
XS2 = IDC-16
XS3 XS5 = IDC-10
XS4 XS4' = STEREO_CONN
XS6-XS8 = NEMOBUS: Type: NEMOBUS
ZQ1 = REZONATOR: Type: REZONATOR
C5 C20 C22 C23 = CP: Type: CP
DD30 = 27512: Type: 27512